# EAGLE design yrl039-1_0 (EAGLE 9.5.0)

## Sheet 1 of 2: Pi, Power, Connectors
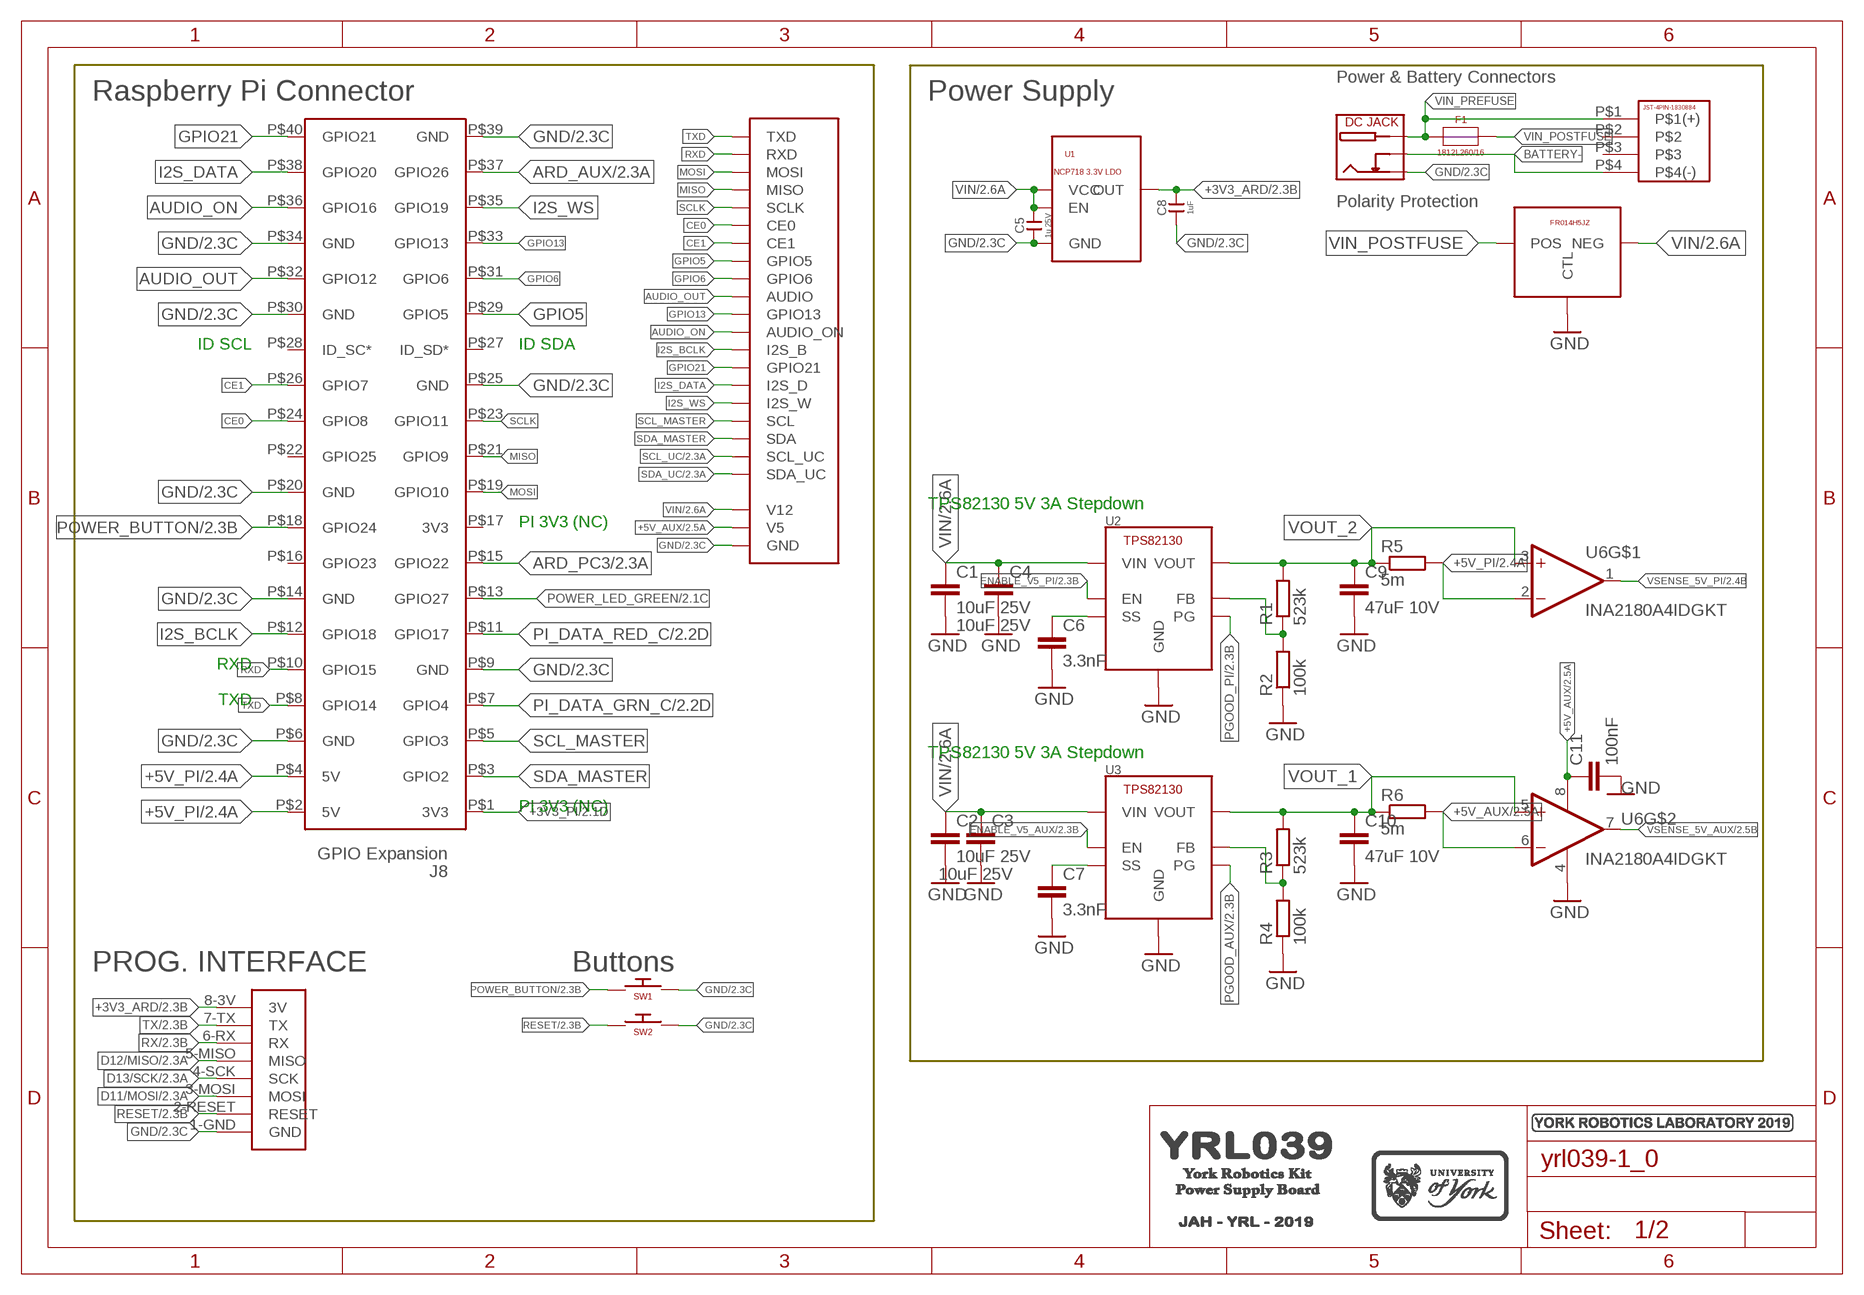
[diagram p0: schematic, sheet 1]

### Parts
C1  10uF 25V  C-EUC1210  [C1210]
C2  10uF 25V  C-EUC1210  [C1210]
C3  10uF 25V  C-EUC1210  [C1210]
C4  10uF 25V  C-EUC1210  [C1210]
C5  1u 25V  CAPACITOR-0805  [0805]
C6  3.3nF  C-EUC0603  [C0603]
C7  3.3nF  C-EUC0603  [C0603]
C8  1uF  CAPACITOR-0805  [0805]
C9  47uF 10V  C-EUC1210  [C1210]
C10  47uF 10V  C-EUC1210  [C1210]
C11  100nF  C-EUC0603  [C0603]
F1  1812L260/16  PTC-FUSE-1812L260/16-2786593  [PTC-FUSE-1812L260/16]
J1  8-PIN-ARD-CON-LHS  [8-PIN-CONNECTOR-LHS]
J2  CONNECTOR-PAIRS  [CONNECTOR-PAIRS]
J3  DC-JACK-RAPC7222X  [2.1MM-CON-SWITCHCRAFT-RAPC722X]
J4  JST-4PIN-RA-1516291  [JST-4PIN-XH-RA-1516291]
LOGO1  YRL039  [YRL039]
LOGO2  UOY-LOGO-30MM  [UY-SS-30MM-WIDE]
LOGO3  YRL-2019-LOGO  [YRL2019-LOGO]
PCB1  RPI3  [RPI3]
R1  523k  R-EU_R0603  [R0603]
R2  100k  R-EU_R0603  [R0603]
R3  523k  R-EU_R0603  [R0603]
R4  100k  R-EU_R0603  [R0603]
R5  5m  R-EU_R0805  [R0805]
R6  5m  R-EU_R0805  [R0805]
SW1  SWITCH-9471898  [6X3.5-SWITCH]
SW2  SWITCH-9471898  [6X3.5-SWITCH]
U1  NCP718-3V3LDO-2981166  [INA138-CURRENTSHUNT]
U2  TPS82130  [TPS82130-MODULE]
U3  TPS82130  [TPS82130-MODULE]
U4  FR014H5JZ  [FR014H5JZ]
U6  INA2180A4IDGKT  [SOP65P490X110-9N]

### Nets
+3V3_ARD: C8.P$2 J1.8-3V(3V) U1.P$5(OUT) ; also sheet 2
+3V3_PI: PCB1.P$1(3V3) ; also sheet 2
+5V_AUX: C11.1 J2.V5 R6.2 U6.6(-IN) U6.8(V+) ; also sheet 2
+5V_PI: PCB1.P$2(5V) PCB1.P$4(5V) R5.2 U6.2(-IN) ; also sheet 2
ARD_AUX: PCB1.P$37(GPIO26) ; also sheet 2
ARD_PC3: PCB1.P$15(GPIO22) ; also sheet 2
AUDIO_ON: J2.AUDIO_ON PCB1.P$36(GPIO16)
AUDIO_OUT: J2.AUDIO PCB1.P$32(GPIO12)
BATTERY-: J3.SWITCH J4.P$4(P$4(-))
CE0: J2.CE0 PCB1.P$24(GPIO8)
CE1: J2.CE1 PCB1.P$26(GPIO7)
D11/MOSI: J1.3-MOSI(MOSI) ; also sheet 2
D12/MISO: J1.5-MISO(MISO) ; also sheet 2
D13/SCK: J1.4-SCK(SCK) ; also sheet 2
ENABLE_V5_AUX: U3.P$1(EN) ; also sheet 2
ENABLE_V5_PI: U2.P$1(EN) ; also sheet 2
GND: C1.2 C2.2 C3.2 C4.2 C5.P$1 C6.2 C7.2 C8.P$1 C9.2 C10.2 C11.2 J1.1-GND(GND) J2.GND1(GND) J2.GND2(GND) J3.SLEEVE PCB1.P$6(GND) PCB1.P$9(GND) PCB1.P$14(GND) PCB1.P$20(GND) PCB1.P$25(GND) PCB1.P$30(GND) PCB1.P$34(GND) PCB1.P$39(GND) R2.1 R4.1 SW1.2(SD2) SW2.2(SD2) U1.P$2(GND) U2.P$3(GND) U2.P$9(GND) U3.P$3(GND) U3.P$9(GND) U4.P$4(CTL) U6.4(V-) ; also sheet 2
GPIO5: J2.GPIO5 PCB1.P$29(GPIO5)
GPIO6: J2.GPIO6 PCB1.P$31(GPIO6)
GPIO13: J2.GPIO13 PCB1.P$33(GPIO13)
GPIO21: J2.GPIO21 PCB1.P$40(GPIO21)
I2S_BCLK: J2.I2S_B PCB1.P$12(GPIO18)
I2S_DATA: J2.I2S_D PCB1.P$38(GPIO20)
I2S_WS: J2.I2S_W PCB1.P$35(GPIO19)
MISO: J2.MISO PCB1.P$21(GPIO9)
MOSI: J2.MOSI PCB1.P$19(GPIO10)
N$8: C7.1 U3.P$8(SS)
N$9: R3.1 R4.2 U3.P$6(FB)
N$10: C6.1 U2.P$8(SS)
N$11: R1.1 R2.2 U2.P$6(FB)
PGOOD_AUX: U3.P$7(PG) ; also sheet 2
PGOOD_PI: U2.P$7(PG) ; also sheet 2
PI_DATA_GRN_C: PCB1.P$7(GPIO4) ; also sheet 2
PI_DATA_RED_C: PCB1.P$11(GPIO17) ; also sheet 2
POWER_BUTTON: PCB1.P$18(GPIO24) SW1.1(SD1) ; also sheet 2
POWER_LED_GREEN: PCB1.P$13(GPIO27) ; also sheet 2
RESET: J1.2-RESET(RESET) SW2.1(SD1) ; also sheet 2
RX: J1.6-RX(RX) ; also sheet 2
RXD: J2.RXD PCB1.P$10(GPIO15)
SCL_MASTER: J2.SCL PCB1.P$5(GPIO3)
SCL_UC: J2.SCL_UC ; also sheet 2
SCLK: J2.SCLK PCB1.P$23(GPIO11)
SDA_MASTER: J2.SDA PCB1.P$3(GPIO2)
SDA_UC: J2.SDA_UC ; also sheet 2
TX: J1.7-TX(TX) ; also sheet 2
TXD: J2.TXD PCB1.P$8(GPIO14)
VIN: C1.1 C2.1 C3.1 C4.1 C5.P$2 J2.V12 U1.P$1(VCC) U1.P$3(EN) U2.P$2(VIN) U3.P$2(VIN) U4.P$1(NEG) U4.P$2(NEG) U4.P$3(NEG) ; also sheet 2
VIN_POSTFUSE: F1.P$2 U4.P$5(POS) U4.P$6(POS) U4.P$7(POS) U4.P$8(POS) U4.P$9(POS)
VIN_PREFUSE: F1.P$1 J3.PIN J4.P$1(P$1(+))
VOUT_1: C10.1 R3.2 R6.1 U3.P$4(VOUT) U3.P$5(VOUT) U6.5(+IN)
VOUT_2: C9.1 R1.2 R5.1 U2.P$4(VOUT) U2.P$5(VOUT) U6.3(+IN)
VSENSE_5V_AUX: U6.7(OUT) ; also sheet 2
VSENSE_5V_PI: U6.1(OUT) ; also sheet 2
Unconnected: J4.P$2 J4.P$3 PCB1.P$16(GPIO23) PCB1.P$17(3V3) PCB1.P$22(GPIO25) PCB1.P$27(ID_SD*) PCB1.P$28(ID_SC*)

### Notes on the sheet
- Power & Battery Connectors
- Raspberry Pi Connector | Power Supply
- Polarity Protection
- ID SCL | ID SDA
- TPS82130 5V 3A Stepdown
- PI 3V3 (NC)
- RXD
- TXD
- TPS82130 5V 3A Stepdown
- PI 3V3 (NC)
- PROG. INTERFACE | Buttons

## Sheet 2 of 2: Arduino
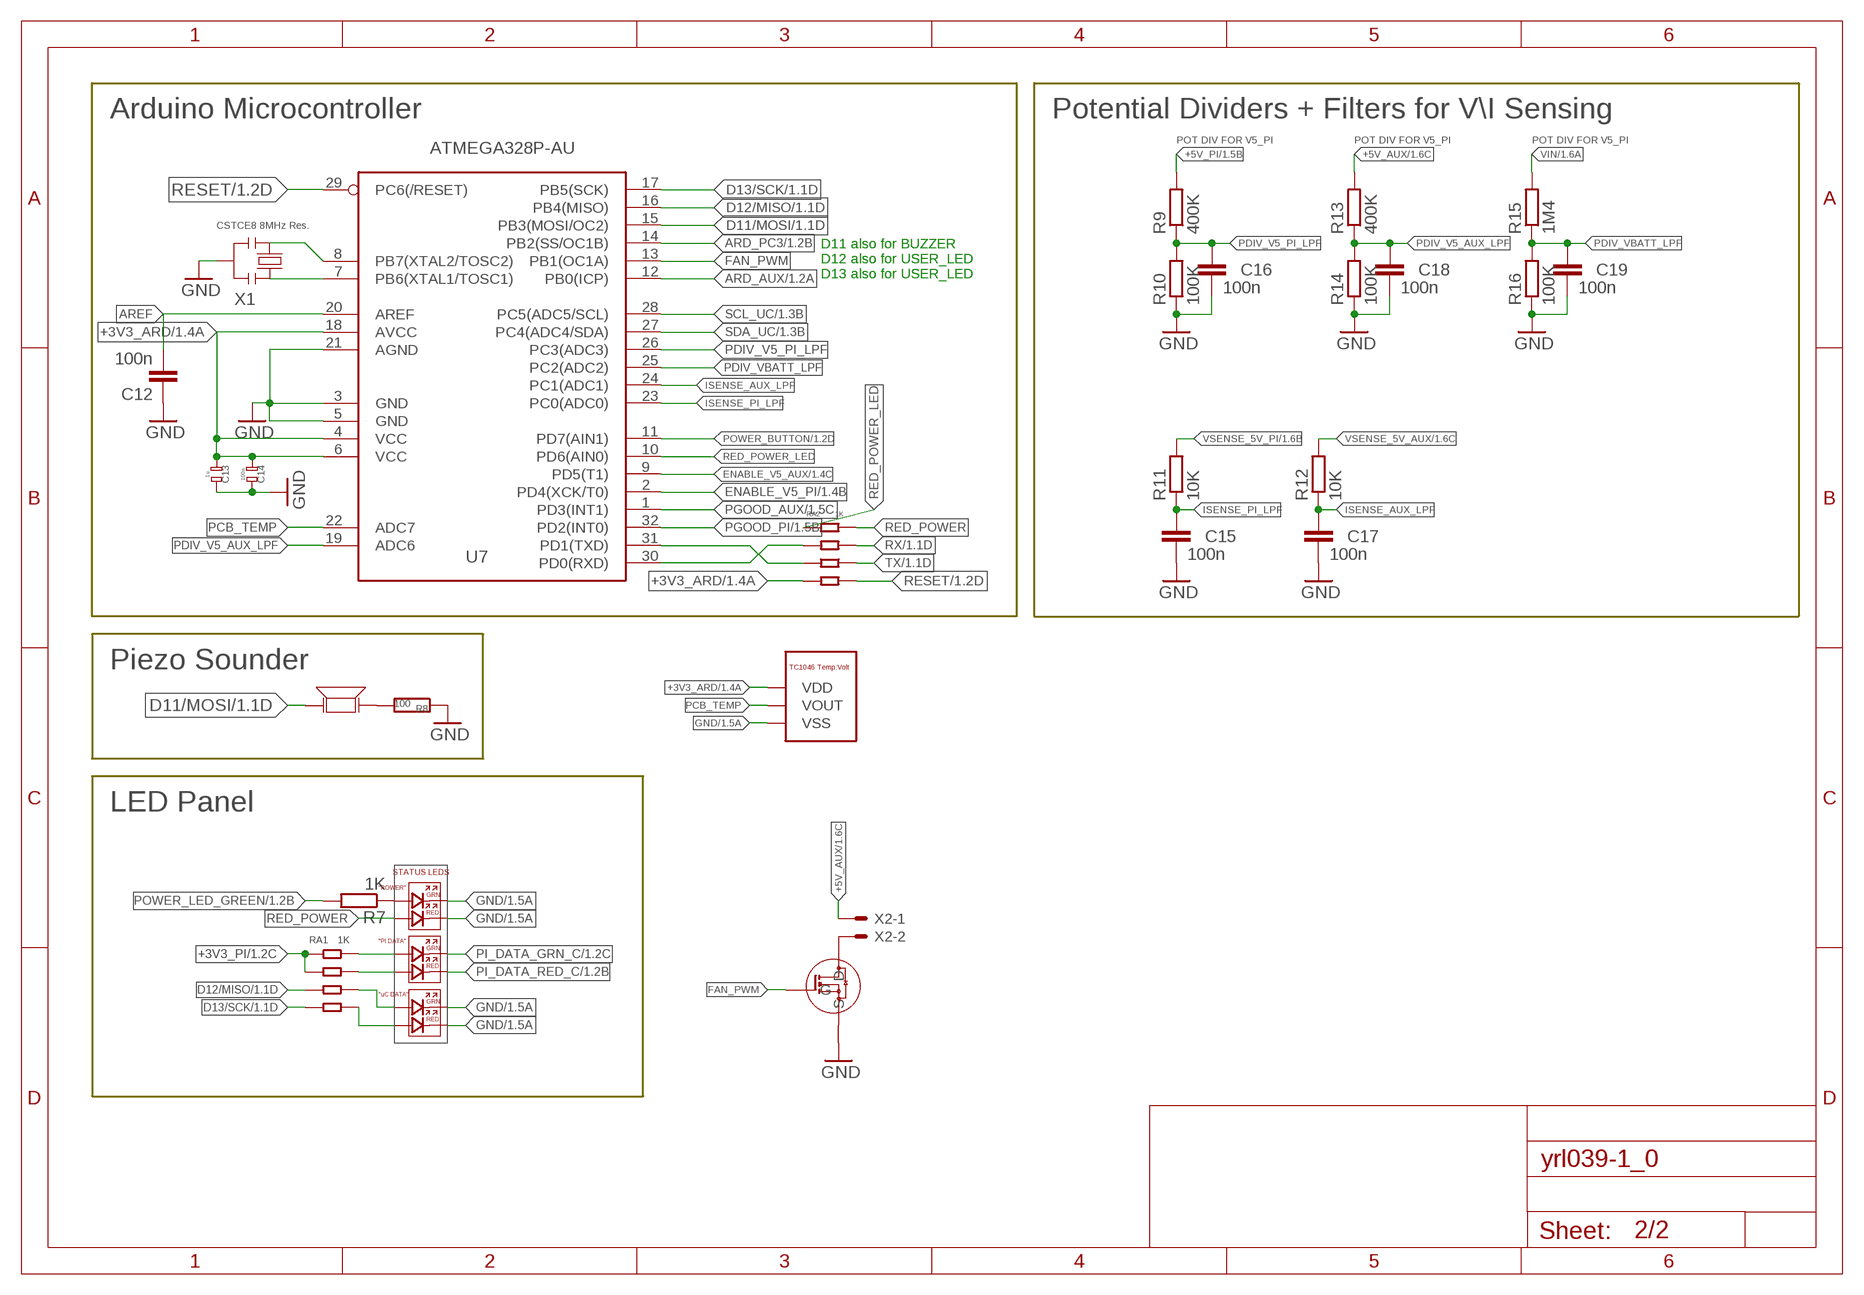
[diagram p1: schematic, sheet 2]

### Parts
C12  100n  C-EUC0603  [C0603]
C13  1u  CAPACITOR-0603  [0603-RESISTOR]
C14  100n  CAPACITOR-0603  [0603-RESISTOR]
C15  100n  C-EUC0603  [C0603]
C16  100n  C-EUC0603  [C0603]
C17  100n  C-EUC0603  [C0603]
C18  100n  C-EUC0603  [C0603]
C19  100n  C-EUC0603  [C0603]
LED1  3-LED-STATUS-PANEL  [3-LED-STATUS]
PZ1  PIEZO-PKMCS0909E4000-2529461  [PKMCS-PIEZO]
Q1  FDV303N-MOSFET-9845020  [FDV303N-SOT-23-NMOS]
R7  1K  R-EU_R0603  [R0603]
R8  100  R-EU_R0603  [R0603]
R9  400K  R-EU_R0603  [R0603]
R10  100K  R-EU_R0603  [R0603]
R11  10K  R-EU_R0603  [R0603]
R12  10K  R-EU_R0603  [R0603]
R13  400K  R-EU_R0603  [R0603]
R14  100K  R-EU_R0603  [R0603]
R15  1M4  R-EU_R0603  [R0603]
R16  100K  R-EU_R0603  [R0603]
RA1  1K  1206-RES-ARRAY-1770134  [1206-RES-ARRAY]
RA2  1K  1206-RES-ARRAY-1770134  [1206-RES-ARRAY]
U5  TC1046-1212685  [TC1046-TEMP-SENSOR]
U7  ATMEGA328P-AU  0265_ATMEGA328P-AU  [TQFP32-08]
X1  CSTCE8 8MHz Res.  0011_CSTCE16M0V53-R0  [RESONATOR]
X2  87758-0216  [87758-0216]

### Nets
+3V3_ARD: C13.1(SD1) C14.1(SD1) RA2.P$4 U5.P$1(VDD) U7.4(VCC) U7.6(VCC) U7.18(AVCC) ; also sheet 1
+3V3_PI: RA1.P$1 RA1.P$2 ; also sheet 1
+5V_AUX: R13.2 X2.1 ; also sheet 1
+5V_PI: R9.2 ; also sheet 1
ARD_AUX: U7.12(PB0(ICP)) ; also sheet 1
ARD_PC3: U7.14(PB2(SS/OC1B)) ; also sheet 1
AREF: C12.2 U7.20(AREF)
D11/MOSI: PZ1.P$1 U7.15(PB3(MOSI/OC2)) ; also sheet 1
D12/MISO: RA1.P$3 U7.16(PB4(MISO)) ; also sheet 1
D13/SCK: RA1.P$4 U7.17(PB5(SCK)) ; also sheet 1
ENABLE_V5_AUX: U7.9(PD5(T1)) ; also sheet 1
ENABLE_V5_PI: U7.2(PD4(XCK/T0)) ; also sheet 1
FAN_PWM: Q1.P$1(G) U7.13(PB1(OC1A))
GND: C12.1 C13.2(SD2) C14.2(SD2) C15.2 C16.2 C17.2 C18.2 C19.2 LED1.PWR_GRN_C LED1.PWR_RED_C LED1.UC_DATA_GRN_C(UCDATA_GRN_C) LED1.UC_DATA_RED_C(UCDATA_RED_C) Q1.P$2(S) R8.1 R10.1 R14.1 R16.1 U5.P$3(VSS) U7.3(GND) U7.5(GND) U7.21(AGND) X1.2 ; also sheet 1
ISENSE_AUX_LPF: C17.1 R12.1 U7.24(PC1(ADC1))
ISENSE_PI_LPF: C15.1 R11.1 U7.23(PC0(ADC0))
N$1: RA2.P$3 U7.31(PD1(TXD))
N$2: RA2.P$2 U7.30(PD0(RXD))
N$3: LED1.PWR_GRN_A R7.1
N$4: Q1.P$3(D) X2.2
N$18: U7.7(PB6(XTAL1/TOSC1)) X1.1
N$19: U7.8(PB7(XTAL2/TOSC2)) X1.3
N$28: PZ1.P$2 R8.2
N$36: LED1.PI_DATA_GRN_A(PIDATA_GRN_A) RA1.P$8
N$37: LED1.PI_DATA_RED_A(PIDATA_RED_A) RA1.P$7
PCB_TEMP: U5.P$2(VOUT) U7.22(ADC7)
PDIV_V5_AUX_LPF: C18.1 R13.1 R14.2 U7.19(ADC6)
PDIV_V5_PI_LPF: C16.1 R9.1 R10.2 U7.26(PC3(ADC3))
PDIV_VBATT_LPF: C19.1 R15.1 R16.2 U7.25(PC2(ADC2))
PGOOD_AUX: U7.1(PD3(INT1)) ; also sheet 1
PGOOD_PI: U7.32(PD2(INT0)) ; also sheet 1
PI_DATA_GRN_C: LED1.PI_DATA_GRN_C(PIDATA_GRN_C) ; also sheet 1
PI_DATA_RED_C: LED1.PI_DATA_RED_C(PIDATA_RED_C) ; also sheet 1
POWER_BUTTON: U7.11(PD7(AIN1)) ; also sheet 1
POWER_LED_GREEN: R7.2 ; also sheet 1
RED_POWER: LED1.PWR_RED_A RA2.P$8
RED_POWER_LED: RA2.P$1 U7.10(PD6(AIN0))
RESET: RA2.P$5 U7.29(PC6(/RESET)) ; also sheet 1
RX: RA2.P$7 ; also sheet 1
SCL_UC: U7.28(PC5(ADC5/SCL)) ; also sheet 1
SDA_UC: U7.27(PC4(ADC4/SDA)) ; also sheet 1
TX: RA2.P$6 ; also sheet 1
UCUSER_GRN_A: LED1.UC_DATA_GRN_A(UCDATA_GRN_A) RA1.P$6
UCUSER_RED_A: LED1.UC_DATA_RED_A(UCDATA_RED_A) RA1.P$5
VIN: R15.2 ; also sheet 1
VSENSE_5V_AUX: R12.2 ; also sheet 1
VSENSE_5V_PI: R11.2 ; also sheet 1

### Notes on the sheet
- Arduino Microcontroller | Potential Dividers + Filters for V\I Sensing
- POT DIV FOR V5_PI | POT DIV FOR V5_PI | POT DIV FOR V5_PI
- D11 also for BUZZER
  D12 also for USER_LED
  D13 also for USER_LED
- Piezo Sounder
- LED Panel

## Library data of the parts
C1-C4 C6 C7 C9-C11 C15-C19 = rcl:C-EU: CAPACITOR, European symbol; SPICEPREFIX: C
C5 C8 = YRL-Passives:CAPACITOR-0805
C12 = rcl:C-EU: CAPACITOR, European symbol
C13 C14 = idea:CAPACITOR-0603
F1 = yrl028-library:PTC-FUSE-1812L260/16-2786593
J1 = yrl029:8-PIN-ARD-CON-LHS
J2 = yrl012-exported:CONNECTOR-PAIRS
J3 = yrl012-exported:DC-JACK-RAPC7222X
J4 = yrl012-exported:JST-4PIN-RA-1516291
LED1 = YRL028-014:3-LED-STATUS-PANEL
LOGO1 = yrl039-library:YRL039
LOGO2 = yrl-logos:UOY-LOGO-30MM
LOGO3 = yrl028-library:YRL-2019-LOGO
PCB1 = YRL028-014:RPI3: Device for Raspberry Pi 3 board created by Dave Young for www.element14.com More information and support community is available at https://www.element14.com/community/community/raspberry-pi
PZ1 = yrl025-andgate:PIEZO-PKMCS0909E4000-2529461
Q1 = yrl039-library:FDV303N-MOSFET-9845020
R1-R7 R9-R16 = rcl:R-EU_: RESISTOR, European symbol; SPICEPREFIX: R
R8 = resistor:R-EU_: RESISTOR, European symbol
RA1 RA2 = yrl012-exported2:1206-RES-ARRAY-1770134
SW1 SW2 = epuck-zero-lib:SWITCH-9471898
U1 = yrl029:NCP718-3V3LDO-2981166
U2 U3 = yrl039-library:TPS82130
U4 = yrl039-library:FR014H5JZ
U5 = yrl039-library:TC1046-1212685
U6 = INA2180A4IDGKT:INA2180A4IDGKT: None; DESCRIPTION: INA2180 Low/High-Side Voltage Output Current-Sense Amplifier Dual Channel -0.2V to 26V 8-Pin VSSOP T/R; DIGI-KEY_PART_NUMBER: 296-47944-1-ND; DIGI-KEY_PURCHASE_URL: https://www.digikey.com/product-detail/en/texas-instruments/INA2180A4IDGKT/296-47944-1-ND/8286320?utm_source=snapeda&utm_medium=aggregator&utm_campaign=symbol; MF: Texas Instruments; MP: INA2180A4IDGKT; PACKAGE: MSOP-8 Texas Instruments
U7 = IntegratedCircuits:0265_ATMEGA328P-AU: 8-bit Microcontroller with 32KBytes In-System Programmable Flash ATMEGA328P-AU; CASE: TQFP32_7x7; MONTHLY_USAGE: _____; PART_NUMBER: ATMEGA328P-AU; PRICE: _____; SUPPLIER: _____; TYPE: Circuito_Integrato
X1 = YRL028-007:0011_CSTCE16M0V53-R0: 16Mhz - SMD; MONTHLY_USAGE: _____; PART_NUMBER: CSTCE16M0V53-R0; PRICE: _____; SUPPLIER: _____; TYPE: Cristalli; VALUE: CSTCE16M0V53-R0
X2 = con-molex:87758-0216: 2 Pin - 2mm Dual Row Single Wafer, Vertical T/H HDR Source: http://www.molex.com/pdm_docs/sd/877580616_sd.pdf; MF: MOLEX; MPN: 87758-0216; OC_FARNELL: unknown; OC_NEWARK: 94M1513

## Board
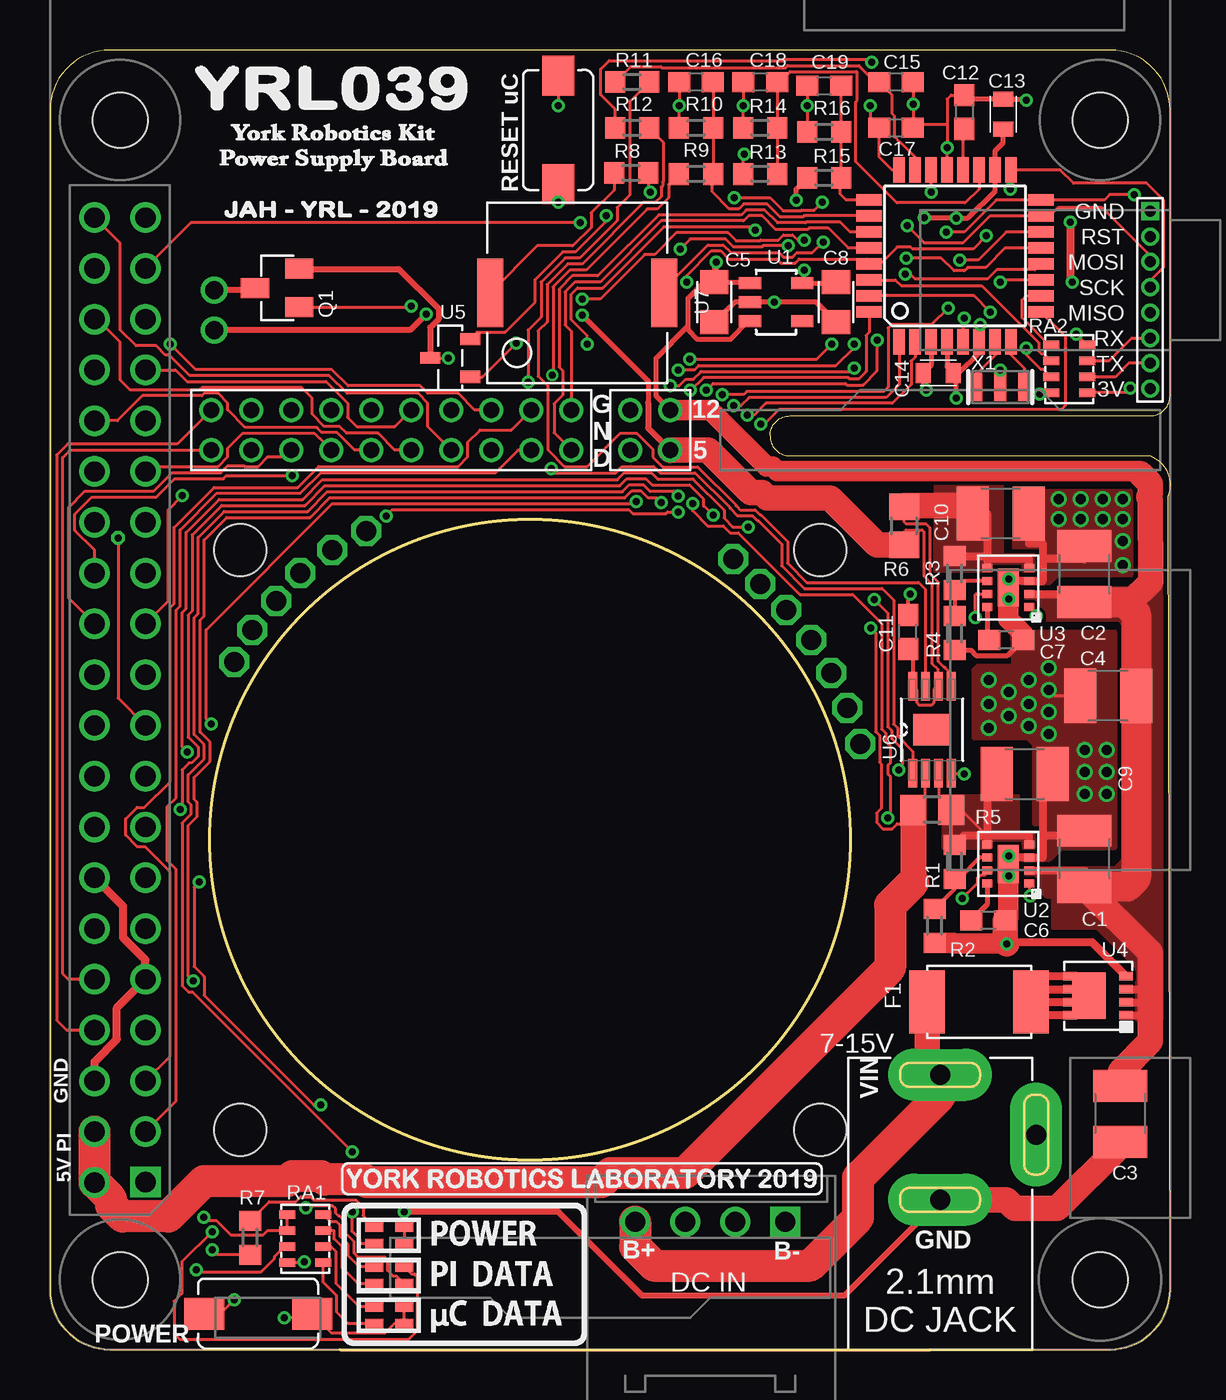
[diagram p2: board, top side]
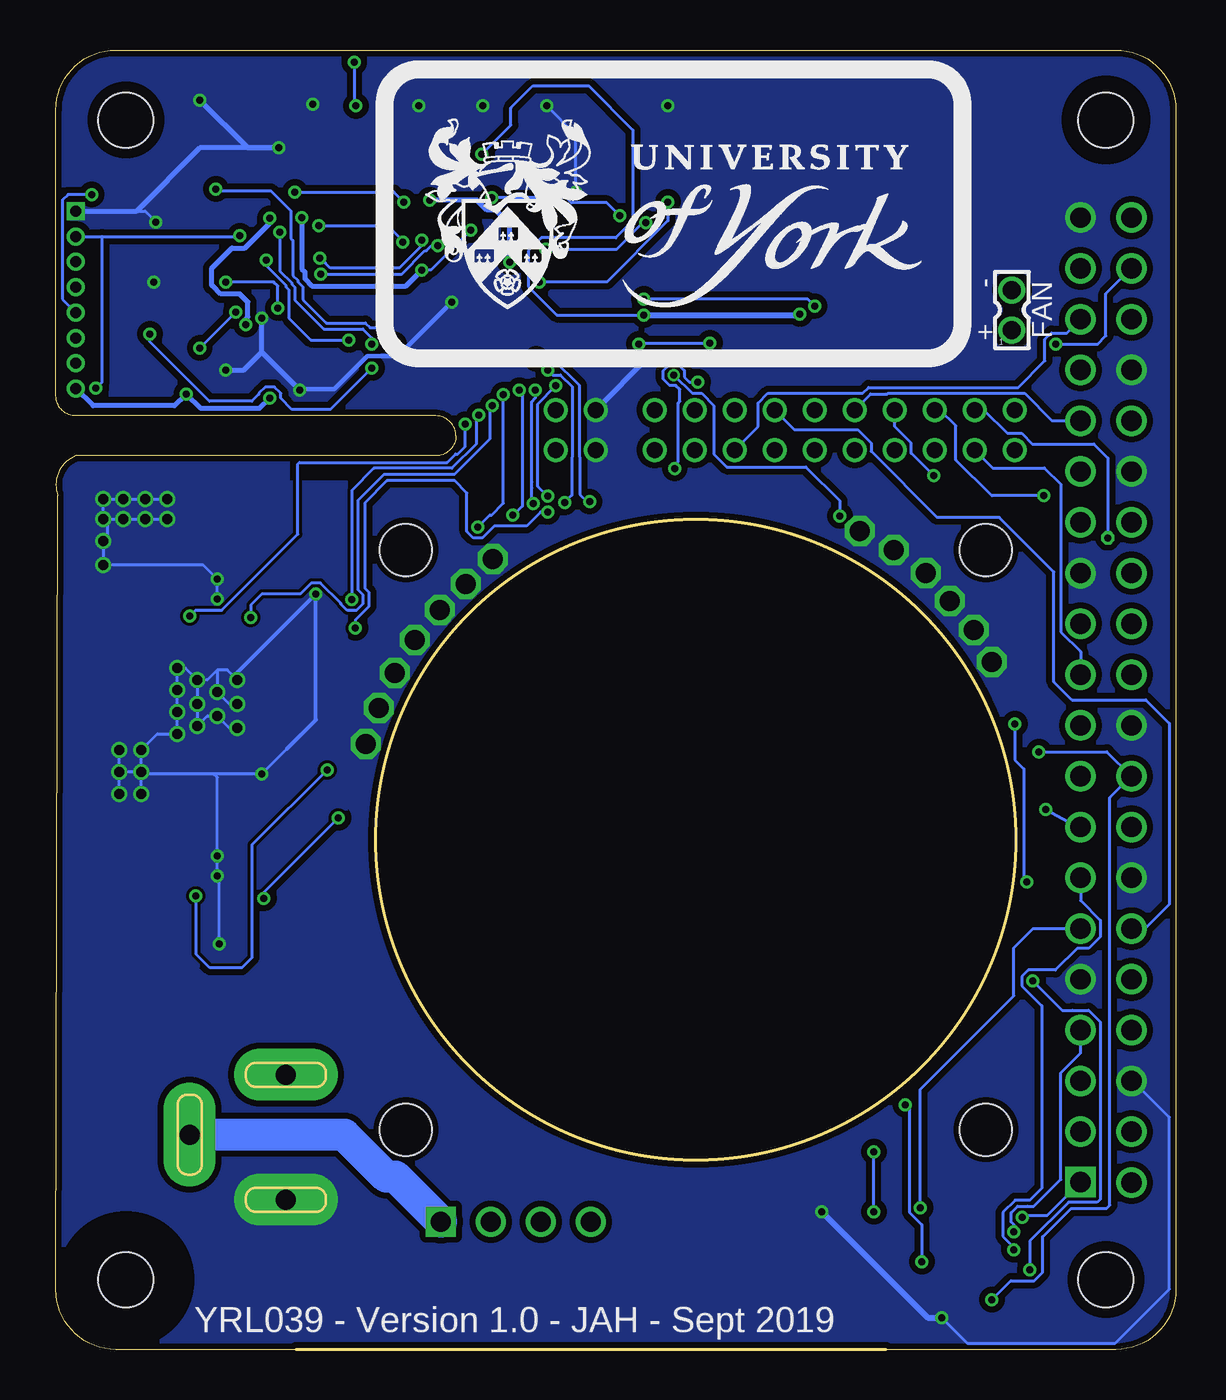
[diagram p3: board, bottom side, seen from below]

Size 56 x 65 mm. Coordinates in mm from the lower left corner, seen from the top.
Outline: 14.5,0 3,0 arc-90 0,3 0,62 arc-90 3,65 53,65 arc-90 56,62 56,47.7 arc-90 55,46.7 37,46.7 arc90 36,45.7 arc90 37,44.7 55,44.7 arc-90 55.9,42.7 56,3 arc-90 53,0 44,0
Outline: 14.5,0 18.5,0
Outline: 37.5,0 44,0
Outline: 14.5,0 44,0
Outline: circle at 24,25.5 radius 16
Copper layers (1*16): Top 0.018mm / dielectric 1.55mm / Bottom 0.018mm
Design rules "eC_2Layer_PClass6_BaseCopperO18_eCDefault": minimum track width 0.15mm, minimum drill 0.35mm, track to track 0.15mm, track to pad 0.15mm, pad to pad 0.15mm, via to via 0.15mm, smd to smd 0mil, copper to edge 0.25mm, drill to drill 0.35mm, minimum pad ring 0.175mm, minimum via ring 0.125mm, stop-mask expansion 0mil, vias tented up to drill 0.45mm, thermal gap 0.2mm
Holes 2.6 mm at 9.5,11 38.5,11 38.5,40 9.5,40
tRestrict: area 2.2,2.2 to 4.8,4.8; area 2.7,60.7 to 4.3,62.3; area 51,60 to 54,63; area 51,1.9 to 54,5
bRestrict: area 51,1.9 to 54,5; area 2,2 to 5,5; area 51.7,60.7 to 53.3,62.3; area 1.7,59.7 to 5.3,63.3
